# EasyEDA Pro project DartCharger.eprj, schematic DartCharger (continued)
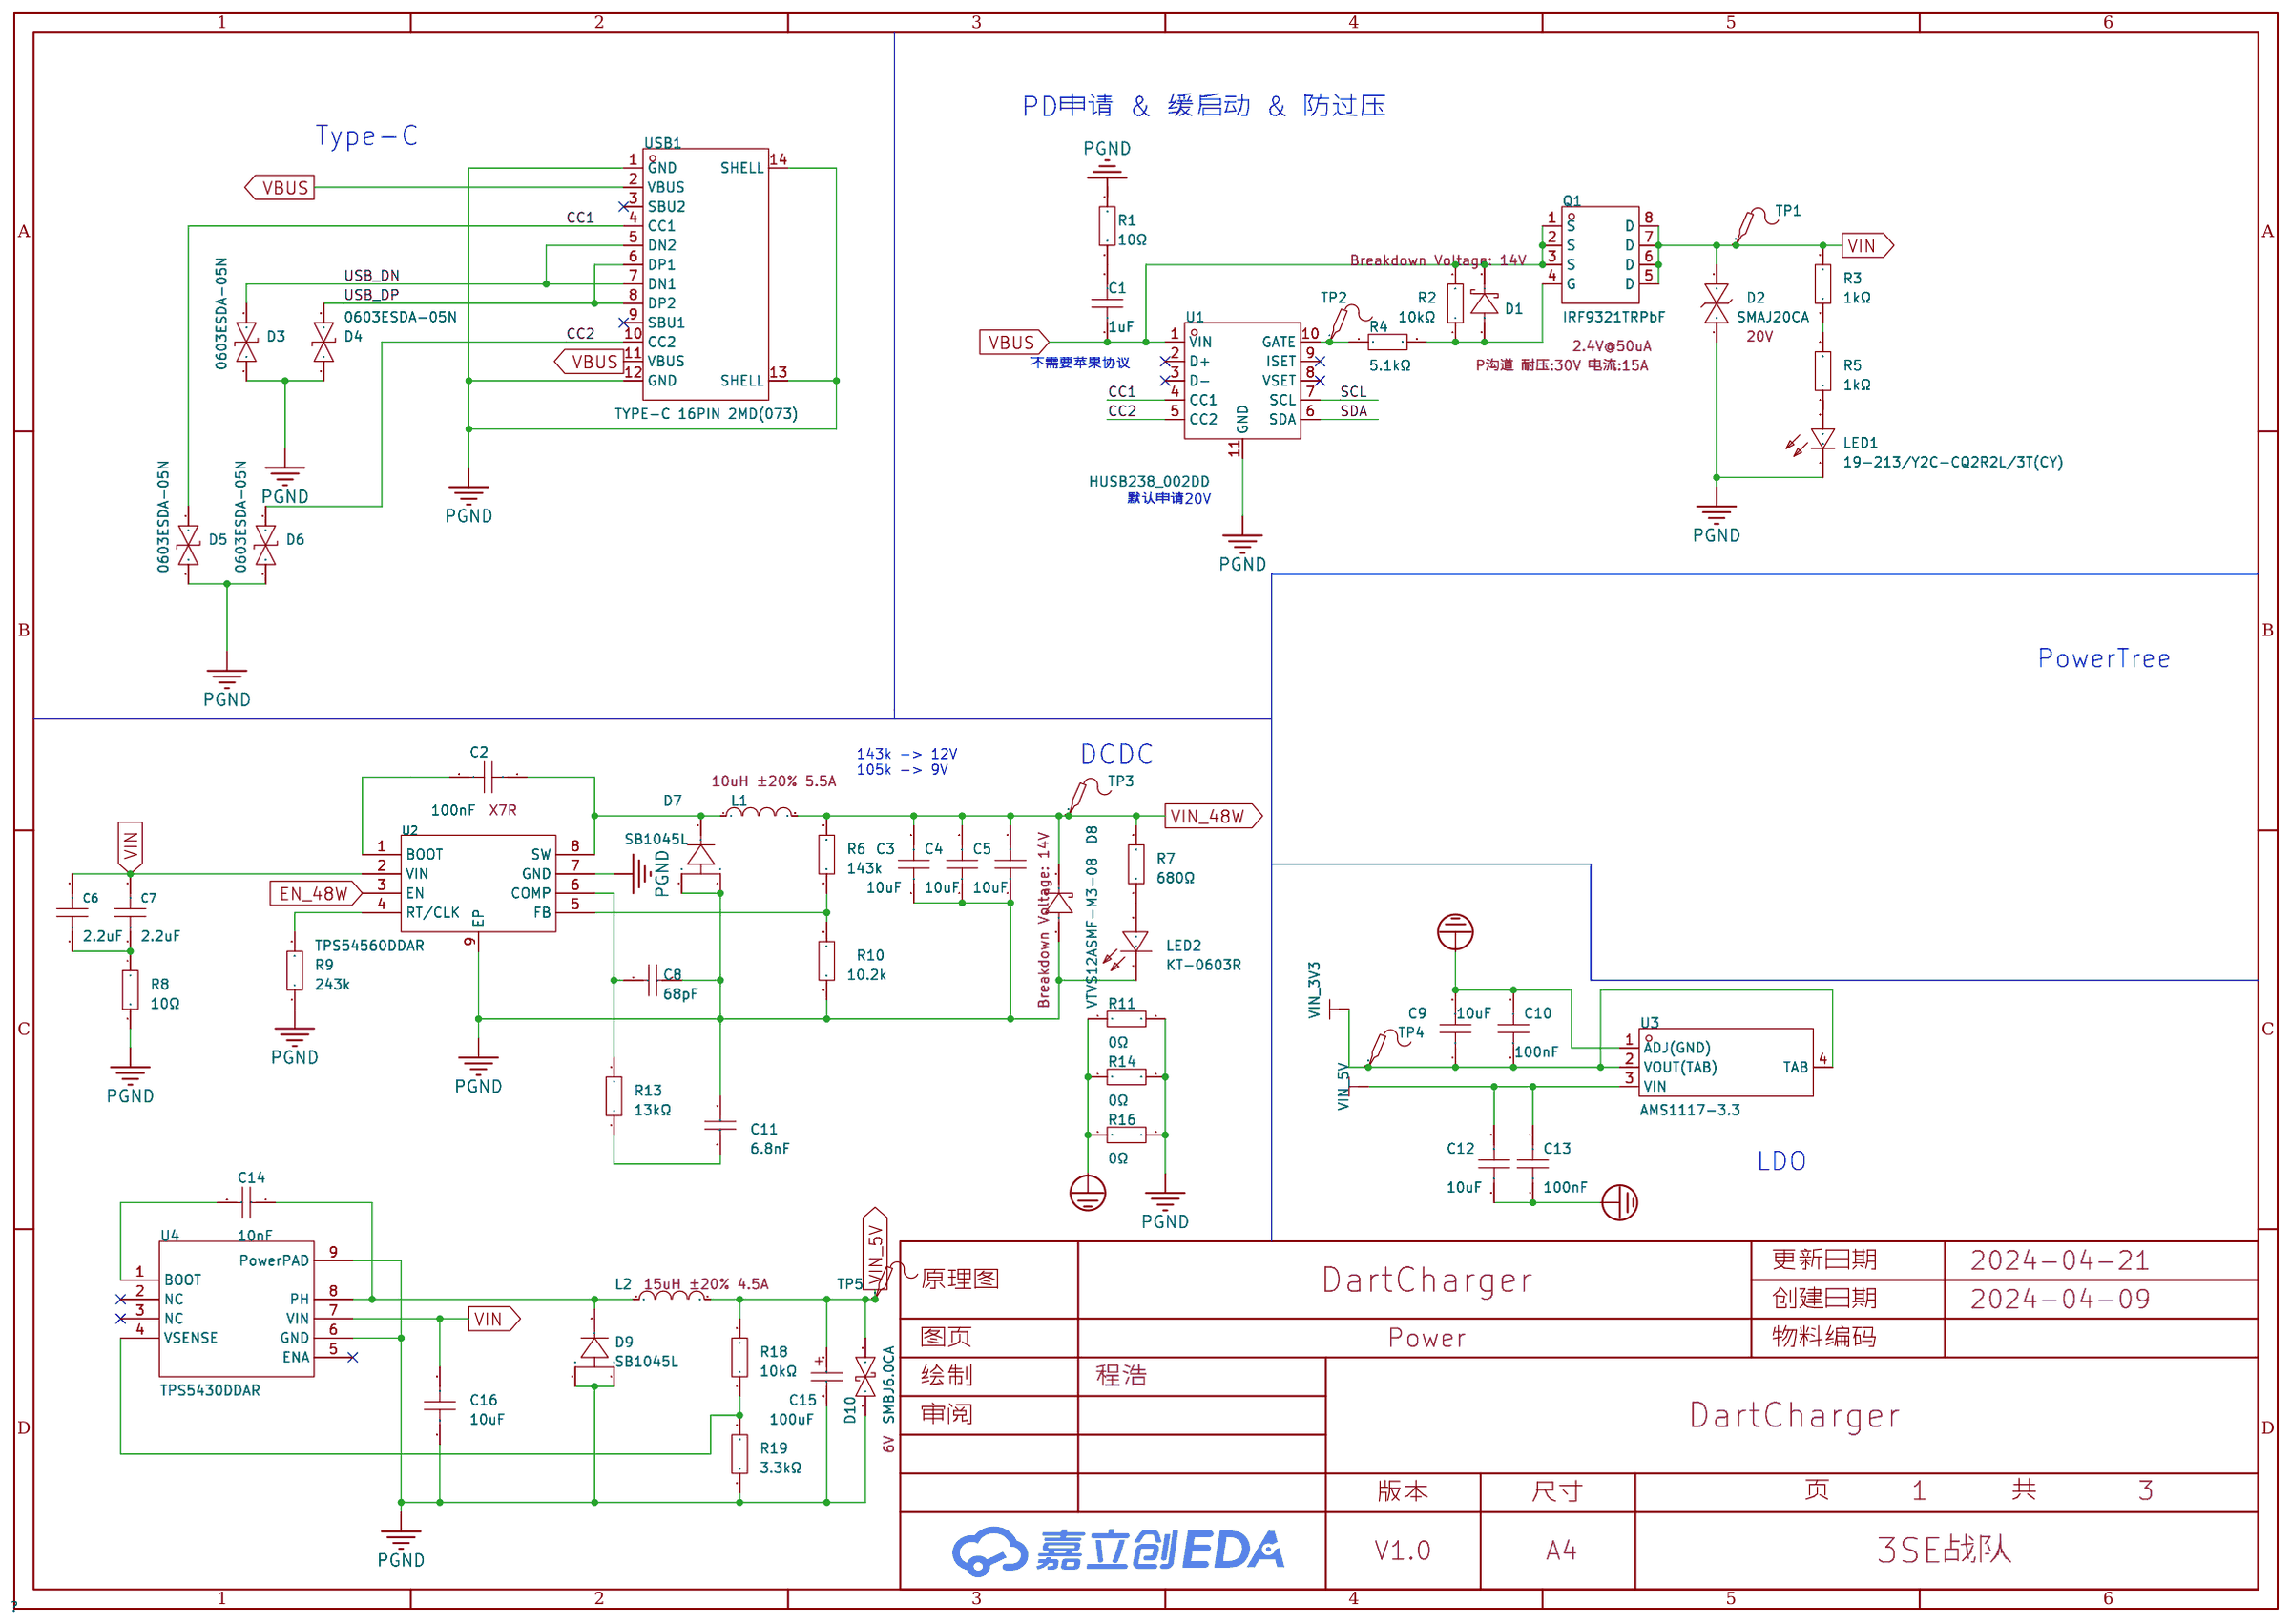
[diagram p0: Power]
## Library data of the parts (continued)
R2 R18 R29 R32 R51 R54 R64 R66 R67 R70 = 0402WGF1002TCE: 电阻类型:厚膜电阻;阻值:10kΩ;精度:±1%;功率:62.5mW;最大工作电压:50V;温度系数:±100ppm/℃;; LCSC Part Name: 10kΩ ±1% 62.5mW 厚膜电阻; Supplier Part: C25744; Manufacturer: UNI-ROYAL(厚声); Supplier Footprint: 0402; JLCPCB Part Class: 基础库; Datasheet: https://atta.szlcsc.com/upload/public/pdf/source/20200306/C422600_1E6D84923E4A46A82E41ADD87F860B5C.pdf; Supplier: LCSC; Type: 厚膜电阻; Tolerance: ±1%; Power(Watts): 62.5mW; Overload Voltage (Max): 50V; Temperature Coefficient: ±100ppm/℃; Operating Temperature Range: -55℃~+155℃
R65 = 0603WAF1002T5E: 电阻类型:厚膜电阻;阻值:10kΩ;精度:±1%;功率:100mW;最大工作电压:75V;温度系数:±100ppm/℃;; LCSC Part Name: 厚膜电阻 10kΩ ±1% 100mW; Supplier Part: C25804; Manufacturer: UNI-ROYAL(厚声); Supplier Footprint: 0603; JLCPCB Part Class: 基础库; Datasheet: https://atta.szlcsc.com/upload/public/pdf/source/20200306/C422600_1E6D84923E4A46A82E41ADD87F860B5C.pdf; Supplier: LCSC; Type: 厚膜电阻; Tolerance: ±1%; Power(Watts): 100mW; Overload Voltage (Max): 75V; Temperature Coefficient: ±100ppm/℃; Operating Temperature Range: -55℃~+155℃
R68 R69 = 0402WGF2001TCE: 电阻类型:厚膜电阻;阻值:2kΩ;精度:±1%;功率:62.5mW;最大工作电压:50V;温度系数:±100ppm/℃;; LCSC Part Name: 2kΩ ±1% 62.5mW 厚膜电阻; Supplier Part: C4109; Manufacturer: UNI-ROYAL(厚声); Supplier Footprint: 0402; JLCPCB Part Class: 基础库; Datasheet: https://atta.szlcsc.com/upload/public/pdf/source/20200306/C422600_1E6D84923E4A46A82E41ADD87F860B5C.pdf; Supplier: LCSC; Type: 厚膜电阻; Tolerance: ±1%; Power(Watts): 62.5mW; Overload Voltage (Max): 50V; Temperature Coefficient: ±100ppm/℃; Operating Temperature Range: -55℃~+155℃
SW1 SW2 = TS-1101-C-W: 触点电流:50mA;额定电压(AC):-;额定电压(DC):12V;额定功率:-;绝缘电阻:-;电路结构:单刀单掷;安装方式:立贴;带灯:无;作用力:260gf;机械寿命:5万次;带支架:否;; LCSC Part Name: 立贴 6*3.6*2.5mm 轻触开关 一型3*6*2.5有白ZD b拉伸白色带淡绿按键 卷装; Supplier Part: C318938; Manufacturer: XKB Connectivity(中国星坤); Supplier Footprint: SMD; JLCPCB Part Class: 扩展库; Datasheet: https://atta.szlcsc.com/upload/public/pdf/source/20200227/C318938_C2E53B1EEDE37D980A33616AC086DE53.pdf; Supplier: LCSC; Contact Current: 50mA; Voltage Rating (DC): 12V; Circuit: 单刀单掷; Mounting Style: 立贴; Actuator Style: 矩形按钮; Actuator/Cap Color: 白色带淡绿; With Lamp: 无; Operating Force: 260gf; Mechanical Life: 5万次; Operating Temperature: -30℃~+85℃; Switch Length: 6mm; Switch Width: 3.6mm; Switch Height: 2.5mm; Strike Gundam: 否
TP1-TP8 = Test-Point: Test Point 测试点
U9 = ESP32-S3-WROOM-1-N8R8: Supplier Part: C2913201; Manufacturer: ESPRESSIF(乐鑫); Supplier Footprint: SMD,25.5x18mm; JLCPCB Part Class: 扩展库; Datasheet: https://atta.szlcsc.com/upload/public/pdf/source/20240130/9D71F4DF55874C504AB629FEEE3F038E.pdf; Supplier: LCSC
C2 C10 C13 C28 C32-C34 C41 C42 C54 C58-C60 C67 C68 = CC0603KRX7R9BB104: 容值:100nF;精度:±10%;额定电压:50V;材质(温度系数):X7R;; LCSC Part Name: 100nF ±10% 50V; Supplier Part: C14663; Manufacturer: YAGEO(国巨); Supplier Footprint: 0603; JLCPCB Part Class: 基础库; Datasheet: https://atta.szlcsc.com/upload/public/pdf/source/20180910/C282072_33301C7F631E79921B82A8DAC6BCC5B3.pdf; Supplier: LCSC; Tolerance: ±10%; Voltage Rated: 50V; Temperature Coefficient: X7R
C3-C5 = CL31B106KBHNNNE: 容值:10uF;精度:±10%;额定电压:50V;材质(温度系数):X7R;; LCSC Part Name: 10uF ±10% 50V; Supplier Part: C89632; Manufacturer: SAMSUNG(三星); Supplier Footprint: 1206; JLCPCB Part Class: 扩展库; Datasheet: https://atta.szlcsc.com/upload/public/pdf/source/20161130/1480498807789.pdf; Supplier: LCSC; Tolerance: ±10%; Voltage Rated: 50V; Temperature Coefficient: X7R
C6 C7 = CL10A225KB8NNNC: 容值:2.2uF;精度:±10%;额定电压:50V;材质(温度系数):X5R;; LCSC Part Name: 2.2uF ±10% 50V; Supplier Part: C913904; Manufacturer: SAMSUNG(三星); Supplier Footprint: 0603; JLCPCB Part Class: 扩展库; Datasheet: https://atta.szlcsc.com/upload/public/pdf/source/20160218/1457707763339.pdf; Supplier: LCSC; Tolerance: ±10%; Voltage Rated: 50V; Temperature Coefficient: X5R
C8 = CL10C680JB8NNNC: 容值:68pF;精度:±5%;额定电压:50V;材质(温度系数):C0G;; LCSC Part Name: 68pF ±5% 50V; Supplier Part: C28262; Manufacturer: SAMSUNG(三星); Supplier Footprint: 0603; JLCPCB Part Class: 扩展库; Datasheet: https://atta.szlcsc.com/upload/public/pdf/source/20160218/1457707763339.pdf; Supplier: LCSC; Tolerance: ±5%; Voltage Rated: 50V; Temperature Coefficient: C0G
C9 C12 = CL10A106KP8NNNC: 容值:10uF;精度:±10%;额定电压:10V;材质(温度系数):X5R;; LCSC Part Name: 10uF ±10% 10V; Supplier Part: C19702; Manufacturer: SAMSUNG(三星); Supplier Footprint: 0603; JLCPCB Part Class: Basic Part; Datasheet: https://atta.szlcsc.com/upload/public/pdf/source/20160218/1457707763339.pdf; Supplier: LCSC; Tolerance: ±10%; Voltage Rated: 10V; Temperature Coefficient: X5R
C11 = 0603B682K500NT: 容值:6.8nF;精度:±10%;额定电压:50V;材质(温度系数):X7R;; LCSC Part Name: 6.8nF ±10% 50V; Supplier Part: C1631; Manufacturer: FH(风华); Supplier Footprint: 0603; JLCPCB Part Class: 基础库; Datasheet: https://atta.szlcsc.com/upload/public/pdf/source/20200305/C486355_26A10D38EF8C2A5C37091D0039909270.pdf; Supplier: LCSC; Tolerance: ±10%; Voltage Rated: 50V; Temperature Coefficient: X7R
C14 C39 C40 C65 C66 = 0603B103K500NT: 容值:10nF;精度:±10%;额定电压:50V;材质(温度系数):X7R;; LCSC Part Name: 10nF ±10% 50V; Supplier Part: C57112; Manufacturer: FH(风华); Supplier Footprint: 0603; JLCPCB Part Class: 基础库; Datasheet: https://atta.szlcsc.com/upload/public/pdf/source/20200305/C486355_26A10D38EF8C2A5C37091D0039909270.pdf; Supplier: LCSC; Tolerance: ±10%; Voltage Rated: 50V; Temperature Coefficient: X7R
C15 = TAJB107K006RNJ: 容值:100uF;精度:±10%;额定电压:6.3V;等效串联电阻:1.7Ω@100kHz;; LCSC Part Name: 100uF ±10% 6.3V; Supplier Part: C16133; Manufacturer: Kyocera AVX; Supplier Footprint: CASE-B-3528; JLCPCB Part Class: 基础库; Datasheet: https://atta.szlcsc.com/upload/public/pdf/source/20160107/1457707750344.pdf; Supplier: LCSC; Tolerance: ±10%; Rated Voltage: 6.3V; Equivalent Series Resistance(ESR): 1.7Ω@100kHz; Operating Temperature: -55℃~+125℃
C16 = CL10A106MA8NRNC: 容值:10uF;精度:±20%;额定电压:25V;材质(温度系数):X5R;; LCSC Part Name: 10uF ±20% 25V; Supplier Part: C96446; Manufacturer: SAMSUNG(三星); Supplier Footprint: 0603; JLCPCB Part Class: 基础库; Datasheet: https://atta.szlcsc.com/upload/public/pdf/source/20160218/1457707763339.pdf; Supplier: LCSC; Tolerance: ±20%; Voltage Rated: 25V; Temperature Coefficient: X5R
D1 D8 = VTVS12ASMF-M3-08: 反向截止电压(Vrwm):12.4V;最大钳位电压:20.1V;峰值脉冲电流(Ipp)@10/1000us:19.01A;峰值脉冲功率(Ppp)@10/1000us:400W;击穿电压:14V;; Supplier Part: C1856655; Manufacturer: VISHAY(威世); Supplier Footprint: DO-219AB(SMF); JLCPCB Part Class: 扩展库; Datasheet: https://atta.szlcsc.com/upload/public/pdf/source/20210601/A9A054684D086DF0A118DDF918624B00.pdf; Supplier: LCSC; Reverse Stand-Off Voltage (Vrwm): 12.4V; Maximum Clamping Voltage: 20.1V; Peak Pulse Current (Ipp)@10/1000us: 19.01A; Peak Pulse Power Dissipation (Ppp)@10/1000us: 400W; Breakdown Voltage: 14V; Type: TVS
D2 = SMAJ20CA_1: 20V; Supplier Part: C19077540; Manufacturer: 宏迦橙; Supplier Footprint: SMA; Datasheet: https://atta.szlcsc.com/upload/public/pdf/source/20231129/0C227A9DBE0C7CC8A214145DDE9DB6E3.pdf; Supplier: LCSC
D7 D9 = SB1045L_C908747: 二极管配置:独立式;正向压降(Vf):530mV@10A;直流反向耐压(Vr):45V;平均整流电流(Io):10A;; LCSC Part Name: 电压:45V 电流:10A; Supplier Part: C908747; Manufacturer: GOODWORK(固得沃克); Supplier Footprint: TO-277; JLCPCB Part Class: 扩展库; Datasheet: https://atta.szlcsc.com/upload/public/pdf/source/20210105/C908747_DE348528BC53D9CC51537B568EB9903F.pdf; Supplier: LCSC; Diode Configuration: 独立式; Forward Voltage (Vf@If): 530mV@10A; Reverse Voltage (Vr): 45V; Average Rectified Current (Io): 10A; Reverse Leakage Current (Ir): 150uA@45V
D10 = SMBJ6.0CA_C113977: 反向截止电压(Vrwm):6V;最大钳位电压:10.3V;峰值脉冲电流(Ipp)@10/1000us:58.3A;击穿电压:6.67V;; LCSC Part Name: 双向 Vrwm:6V; Supplier Part: C113977; Manufacturer: MDD; Supplier Footprint: SMB(DO-214AA); JLCPCB Part Class: 扩展库; Datasheet: https://atta.szlcsc.com/upload/public/pdf/source/20230314/C8F66EF07395B88C11214ABD10019202.pdf; Supplier: LCSC; Reverse Stand-Off Voltage (Vrwm): 6V; Maximum Clamping Voltage: 10.3V; Peak Pulse Current (Ipp)@10/1000us: 58.3A; Breakdown Voltage: 6.67V; Reverse Leakage Current (Ir): 800uA; Type: TVS
L1 = FXL0630-100-M: 电感值:10uH;精度:±20%;额定电流:4.5A;饱和电流(Isat):5.5A;类型:一体成型电感;; LCSC Part Name: 10uH ±20% 5.5A; Supplier Part: C167223; Manufacturer: cjiang(长江微电); Supplier Footprint: SMD,6.6x7mm; JLCPCB Part Class: 扩展库; Datasheet: https://atta.szlcsc.com/upload/public/pdf/source/20230516/3A080F5AF8C87BB81C3BA86E5F60E51A.pdf; Supplier: LCSC; Tolerance: ±20%; Rated Current: 4.5A; Saturation Current (Isat): 5.5A; DC Resistance (DCR): 68mΩ; Type: 一体成型电感
L2 = FXL0630-150-M: 电感值:15uH;精度:±20%;额定电流:3A;饱和电流(Isat):4.5A;类型:一体成型电感;; LCSC Part Name: 15uH ±20% 4.5A; Supplier Part: C177243; Manufacturer: cjiang(长江微电); Supplier Footprint: SMD,6.6x7mm; JLCPCB Part Class: 扩展库; Datasheet: https://atta.szlcsc.com/upload/public/pdf/source/20230516/3A080F5AF8C87BB81C3BA86E5F60E51A.pdf; Supplier: LCSC; Tolerance: ±20%; Rated Current: 3A; Saturation Current (Isat): 4.5A; DC Resistance (DCR): 115mΩ; Type: 一体成型电感
LED1 = 19-213/Y2C-CQ2R2L/3T(CY): 发光颜色:黄色;功率:60mW;正向电流:20mA;主波长:585.5nm~591.5nm;二极管配置:-;透镜颜色:无色透明透镜;色温:-;发光角度:120°;载带方式:-;工作温度:-40℃~+85℃;; LCSC Part Name: 黄灯; Supplier Part: C72038; Manufacturer: EVERLIGHT(亿光); Supplier Footprint: 0603; JLCPCB Part Class: 基础库; Datasheet: https://atta.szlcsc.com/upload/public/pdf/source/20160507/1462613613586.pdf; Supplier: LCSC; Emitted Color: 黄色; Power Dissipation: 60mW; Forward Current: 20mA; Dominant Wavelength: 585.5nm~591.5nm; Peak Wavelength: 591nm; Lens Color: 无色透明透镜; Viewing Angle: 120°; Operating Temperature: -40℃~+85℃
LED2 = KT-0603R: 发光颜色:红色;功率:-;正向电流:-;主波长:-;二极管配置:-;透镜颜色:-;色温:-;发光角度:-;载带方式:-;工作温度:-40℃~+85℃;; LCSC Part Name: 0603 红灯 高亮; Supplier Part: C2286; Manufacturer: KENTO; Supplier Footprint: 0603; JLCPCB Part Class: 基础库; Datasheet: https://atta.szlcsc.com/upload/public/pdf/source/20160616/1466072038404.pdf; Supplier: LCSC; Emitted Color: 红色; Operating Temperature: -40℃~+85℃
Q1 = IRF9321TRPbF: 类型:P沟道;漏源电压(Vdss):30V;连续漏极电流(Id):15A;功率(Pd):2.5W;导通电阻(RDS(on)@Vgs,Id):7.2mΩ@10V,15A;阈值电压(Vgs(th)@Id):2.4V@50uA;; LCSC Part Name: P沟道 耐压:30V 电流:15A; Supplier Part: C54807; Manufacturer: Infineon(英飞凌); Supplier Footprint: SOIC-8; JLCPCB Part Class: 扩展库; Datasheet: https://atta.szlcsc.com/upload/public/pdf/source/20180112/C54807_15157259574841261832.pdf; Supplier: LCSC; Type: P沟道; Drain Source Voltage (Vdss): 30V; Continuous Drain Current (Id): 15A; Power Dissipation (Pd): 2.5W; Drain Source On Resistance (RDS(on)@Vgs,Id): 7.2mΩ@10V,15A; Gate Threshold Voltage (Vgs(th)@Id): 2.4V@50uA; Total Gate Charge (Qg@Vgs): 98nC@10V; Input Capacitance (Ciss@Vds): 2.59nF@25V; Operating Temperature: -55℃~+150℃@(Tj)
R1 = 0402WGF100JTCE: 电阻类型:厚膜电阻;阻值:10Ω;精度:±1%;功率:62.5mW;最大工作电压:50V;温度系数:±200ppm/℃;; LCSC Part Name: 10Ω ±1% 62.5mW 厚膜电阻; Supplier Part: C25077; Manufacturer: UNI-ROYAL(厚声); Supplier Footprint: 0402; JLCPCB Part Class: 基础库; Datasheet: https://atta.szlcsc.com/upload/public/pdf/source/20200306/C422600_1E6D84923E4A46A82E41ADD87F860B5C.pdf; Supplier: LCSC; Type: 厚膜电阻; Tolerance: ±1%; Power(Watts): 62.5mW; Overload Voltage (Max): 50V; Temperature Coefficient: ±200ppm/℃; Operating Temperature Range: -55℃~+155℃
R3 R5 = 0603WAF1001T5E: 电阻类型:厚膜电阻;阻值:1kΩ;精度:±1%;功率:100mW;最大工作电压:75V;温度系数:±100ppm/℃;; LCSC Part Name: 1kΩ ±1% 100mW 厚膜电阻; Supplier Part: C21190; Manufacturer: UNI-ROYAL(厚声); Supplier Footprint: 0603; JLCPCB Part Class: 基础库; Datasheet: https://atta.szlcsc.com/upload/public/pdf/source/20200306/C422600_1E6D84923E4A46A82E41ADD87F860B5C.pdf; Supplier: LCSC; Type: 厚膜电阻; Tolerance: ±1%; Power(Watts): 100mW; Overload Voltage (Max): 75V; Temperature Coefficient: ±100ppm/℃; Operating Temperature Range: -55℃~+155℃
R4 = 0402WGF5101TCE: 电阻类型:厚膜电阻;阻值:5.1kΩ;精度:±1%;功率:62.5mW;最大工作电压:50V;温度系数:±100ppm/℃;; LCSC Part Name: 5.1kΩ ±1% 62.5mW 厚膜电阻; Supplier Part: C25905; Manufacturer: UNI-ROYAL(厚声); Supplier Footprint: 0402; JLCPCB Part Class: 基础库; Datasheet: https://atta.szlcsc.com/upload/public/pdf/source/20200306/C422600_1E6D84923E4A46A82E41ADD87F860B5C.pdf; Supplier: LCSC; Type: 厚膜电阻; Tolerance: ±1%; Power(Watts): 62.5mW; Overload Voltage (Max): 50V; Temperature Coefficient: ±100ppm/℃; Operating Temperature Range: -55℃~+155℃
R6 R9 R10 = Res_0603: Supplier Footprint: 0603
R7 = 0805W8F6800T5E: 电阻类型:厚膜电阻;阻值:680Ω;精度:±1%;功率:125mW;最大工作电压:150V;温度系数:±100ppm/℃;; LCSC Part Name: 680Ω ±1% 125mW 厚膜电阻; Supplier Part: C17798; Manufacturer: UNI-ROYAL(厚声); Supplier Footprint: 0805; JLCPCB Part Class: 基础库; Datasheet: https://atta.szlcsc.com/upload/public/pdf/source/20200306/C422600_1E6D84923E4A46A82E41ADD87F860B5C.pdf; Supplier: LCSC; Type: 厚膜电阻; Tolerance: ±1%; Power(Watts): 125mW; Overload Voltage (Max): 150V; Temperature Coefficient: ±100ppm/℃; Operating Temperature Range: -55℃~+155℃
R8 = 0603WAF100JT5E: 电阻类型:厚膜电阻;阻值:10Ω;精度:±1%;功率:100mW;最大工作电压:75V;温度系数:±400ppm/℃;; LCSC Part Name: 10Ω ±1% 100mW 厚膜电阻; Supplier Part: C22859; Manufacturer: UNI-ROYAL(厚声); Supplier Footprint: 0603; JLCPCB Part Class: 基础库; Datasheet: https://atta.szlcsc.com/upload/public/pdf/source/20200306/C422600_1E6D84923E4A46A82E41ADD87F860B5C.pdf; Supplier: LCSC; Type: 厚膜电阻; Tolerance: ±1%; Power(Watts): 100mW; Overload Voltage (Max): 75V; Temperature Coefficient: ±400ppm/℃; Operating Temperature Range: -55℃~+155℃
R11 R14 R16 R22 R23 R28 R31 R44 R45 R50 R53 = 0603WAF0000T5E: 电阻类型:厚膜电阻;阻值:0Ω;精度:±1%;功率:100mW;最大工作电压:75V;; LCSC Part Name: 0Ω ±1% 100mW 厚膜电阻; Supplier Part: C21189; Manufacturer: UNI-ROYAL(厚声); Supplier Footprint: 0603; JLCPCB Part Class: 基础库; Datasheet: https://atta.szlcsc.com/upload/public/pdf/source/20200306/C422600_1E6D84923E4A46A82E41ADD87F860B5C.pdf; Supplier: LCSC; Type: 厚膜电阻; Tolerance: ±1%; Power(Watts): 100mW; Overload Voltage (Max): 75V; Operating Temperature Range: -55℃~+155℃
R13 = 0603WAF1302T5E: 电阻类型:厚膜电阻;阻值:13kΩ;精度:±1%;功率:100mW;最大工作电压:75V;温度系数:±100ppm/℃;; LCSC Part Name: 13kΩ ±1% 100mW 厚膜电阻; Supplier Part: C22797; Manufacturer: UNI-ROYAL(厚声); Supplier Footprint: 0603; JLCPCB Part Class: 基础库; Datasheet: https://atta.szlcsc.com/upload/public/pdf/source/20200306/C422600_1E6D84923E4A46A82E41ADD87F860B5C.pdf; Supplier: LCSC; Type: 厚膜电阻; Tolerance: ±1%; Power(Watts): 100mW; Overload Voltage (Max): 75V; Temperature Coefficient: ±100ppm/℃; Operating Temperature Range: -55℃~+155℃
R19 R25 R27 R47 R49 = 0402WGF3301TCE: 电阻类型:厚膜电阻;阻值:3.3kΩ;精度:±1%;功率:62.5mW;最大工作电压:50V;温度系数:±100ppm/℃;; LCSC Part Name: 3.3kΩ ±1% 62.5mW 厚膜电阻; Supplier Part: C25890; Manufacturer: UNI-ROYAL(厚声); Supplier Footprint: 0402; JLCPCB Part Class: 基础库; Datasheet: https://atta.szlcsc.com/upload/public/pdf/source/20200306/C422600_1E6D84923E4A46A82E41ADD87F860B5C.pdf; Supplier: LCSC; Type: 厚膜电阻; Tolerance: ±1%; Power(Watts): 62.5mW; Overload Voltage (Max): 50V; Temperature Coefficient: ±100ppm/℃; Operating Temperature Range: -55℃~+155℃
U1 = HUSB238_002DD: HUSB238是一款高度集成的USB PD受电端芯片（PD Sink，也叫PD诱骗芯片）。传输的额定功率可达100W。它兼容PD3.0 V1.3和Type-C V1.4。它还可以支持BC1.2 DCP、CDP和SDP和Apple 5V2.4A充电协议。这种方案也被称为桶形连接器替换(Barrel Connector Replacement)，旨在替代传统的桶形连接器和DC插座(DC JACK)。HUSB238已经获得USB-IF认证，TID3666。它可以用于具有传统桶形连接器或USB micro-B电源; Supplier Part: C7471904; Manufacturer: Hynetek(慧能泰); Supplier Footprint: DFN-10L; JLCPCB Part Class: 扩展库; Datasheet: https://atta.szlcsc.com/upload/public/pdf/source/20240407/14E2BCB22C39B22B34E48E1B6FC2FE3E.pdf; Supplier: LCSC
U2 = TPS54560DDAR: 功能类型:降压型;输出类型:可调;输入电压:4.5V~60V;输出电压:800mV~58.8V;输出电流(最大值):5A;; Supplier Part: C31966; Manufacturer: TI(德州仪器); Supplier Footprint: SOIC-8-EP; JLCPCB Part Class: 扩展库; Datasheet: https://www.ti.com/cn/lit/gpn/tps54560; Supplier: LCSC; Function: 降压型; Output Type: 可调; Input Voltage: 4.5V~60V; Output Voltage: 800mV~58.8V; Output Current (Max): 5A; Switching Frequency: 2.5MHz; Operating Temperature: -40℃~+150℃@(TJ); Synchronous Rectification: 否; Number of Outputs: 1; Topology: 降压式; Switch tube (built-in/external): 内置
U3 = AMS1117-3.3_C347222: 输出类型:固定;最大输入电压:18V;输出电压:3.3V;输出电流:1A;电源纹波抑制比(PSRR):60dB@(120Hz);输出极性:正;; LCSC Part Name: 输入18V 输出3.3V 1A; Supplier Part: C347222; Manufacturer: UMW(友台半导体); Supplier Footprint: SOT-223; JLCPCB Part Class: Extended Part; Datasheet: https://atta.szlcsc.com/upload/public/pdf/source/20231109/155D79A26D9DB04352555A58D5969DC8.pdf; Supplier: LCSC; Output Type: 固定; Output Polarity: 正; Number of Outputs: 1; Maximum Input Voltage: 18V; Output Voltage: 3.3V; Dropout Voltage: 1.3V@(1A); Output Current: 1A; Power Supply Rejection Ratio (PSRR): 60dB@(120Hz)
U4 = TPS5430DDAR: 功能类型:降压型;输出类型:可调;输入电压:5.5V~36V;输出电压:1.221V~32.04V;输出电流(最大值):3A;; LCSC Part Name: 降压 3A 36V; Supplier Part: C9864; Manufacturer: TI(德州仪器); Supplier Footprint: SOIC-8-EP; JLCPCB Part Class: 基础库; Datasheet: https://www.ti.com/cn/lit/gpn/tps5430; Supplier: LCSC; Function: 降压型; Output Type: 可调; Input Voltage: 5.5V~36V; Output Voltage: 1.221V~32.04V; Output Current (Max): 3A; Switching Frequency: 500kHz; Operating Temperature: -40℃~+125℃@(TJ); Synchronous Rectification: 否; Number of Outputs: 1; Topology: 降压式; Switch tube (built-in/external): 内置
USB1 = TYPE-C 16PIN 2MD(073): 连接器类型:Type-C;标准:-;公母:母;端口数量:1;触点数量:16P;安装方式:卧贴;额定电流 - 电源:5A;工作温度范围:-25℃~+85℃;; LCSC Part Name: Type-C 母 卧贴; Supplier Part: C2765186; Manufacturer: SHOU HAN(首韩); Supplier Footprint: SMD; JLCPCB Part Class: 扩展库; Datasheet: https://atta.szlcsc.com/upload/public/pdf/source/20211123/39B17C16241EAC15C5E277BDA434118E.pdf; Supplier: LCSC; Connector Type: Type-C; Gender: 母; Number of Ports: 1; Number of Contacts: 16P; Mounting Style: 卧贴; Current Rating - Power (Max): 5A; Operating Temperature Range: -25℃~+85℃
C17-C20 C43-C46 = CC0603KRX7R9BB153: 容值:15nF;精度:±10%;额定电压:50V;材质(温度系数):X7R;; LCSC Part Name: 15nF ±10% 50V; Supplier Part: C107076; Manufacturer: YAGEO(国巨); Supplier Footprint: 0603; JLCPCB Part Class: 扩展库; Datasheet: https://atta.szlcsc.com/upload/public/pdf/source/20180910/C282072_33301C7F631E79921B82A8DAC6BCC5B3.pdf; Supplier: LCSC; Tolerance: ±10%; Voltage Rated: 50V; Temperature Coefficient: X7R
C21-C24 C47-C50 = 0603B222K500NT: 容值:2.2nF;精度:±10%;额定电压:50V;材质(温度系数):X7R;; LCSC Part Name: 2.2nF ±10% 50V; Supplier Part: C1604; Manufacturer: FH(风华); Supplier Footprint: 0603; JLCPCB Part Class: 基础库; Datasheet: https://atta.szlcsc.com/upload/public/pdf/source/20200305/C486355_26A10D38EF8C2A5C37091D0039909270.pdf; Supplier: LCSC; Tolerance: ±10%; Voltage Rated: 50V; Temperature Coefficient: X7R
C25 C29 C51 C55 = CL10A225KO8NNNC: 容值:2.2uF;精度:±10%;额定电压:16V;材质(温度系数):X5R;; LCSC Part Name: 2.2uF ±10% 16V; Supplier Part: C23630; Manufacturer: SAMSUNG(三星); Supplier Footprint: 0603; JLCPCB Part Class: 基础库; Datasheet: https://atta.szlcsc.com/upload/public/pdf/source/20160218/1457707763339.pdf; Supplier: LCSC; Tolerance: ±10%; Voltage Rated: 16V; Temperature Coefficient: X5R
C26 C27 C30 C31 C52 C53 C56 C57 = CL21A226MAQNNNE: 容值:22uF;精度:±20%;额定电压:25V;材质(温度系数):X5R;; LCSC Part Name: 22uF ±20% 25V; Supplier Part: C45783; Manufacturer: SAMSUNG(三星); Supplier Footprint: 0805; JLCPCB Part Class: 基础库; Datasheet: https://atta.szlcsc.com/upload/public/pdf/source/20160218/1457707763339.pdf; Supplier: LCSC; Tolerance: ±20%; Voltage Rated: 25V; Temperature Coefficient: X5R
C35-C38 C61-C64 = CL10B104KB8NNNC: 容值:100nF;精度:±10%;额定电压:50V;材质(温度系数):X7R;; LCSC Part Name: 100nF ±10% 50V; Supplier Part: C1591; Manufacturer: SAMSUNG(三星); Supplier Footprint: 0603; JLCPCB Part Class: 扩展库; Datasheet: https://atta.szlcsc.com/upload/public/pdf/source/20160218/1457707763339.pdf; Supplier: LCSC; Tolerance: ±10%; Voltage Rated: 50V; Temperature Coefficient: X7R
D11-D14 = B5819W SL: 正向压降(Vf):600mV@1A;直流反向耐压(Vr):40V;平均整流电流(Io):1A;; LCSC Part Name: 电压:40V 电流:1A; Supplier Part: C8598; Manufacturer: CJ(江苏长电/长晶); Supplier Footprint: SOD-123; JLCPCB Part Class: 基础库; Datasheet: https://atta.szlcsc.com/upload/public/pdf/source/20171228/C164911_15144413243851213914.pdf; Supplier: LCSC; Forward Voltage (Vf@If): 600mV@1A; Reverse Voltage (Vr): 40V; Average Rectified Current (Io): 1A
LED3 LED4 LED7 LED8 = KT-0805Y: 发光颜色:黄色;功率:-;正向电流:-;主波长:-;二极管配置:-;透镜颜色:-;色温:-;发光角度:-;载带方式:-;工作温度:-;; LCSC Part Name: 0805 黄灯 高亮; Supplier Part: C2296; Manufacturer: KENTO; Supplier Footprint: 0805; JLCPCB Part Class: 基础库; Datasheet: https://atta.szlcsc.com/upload/public/pdf/source/20160421/1461205044170.pdf; Supplier: LCSC; Emitted Color: 黄色
LED5 LED6 LED9 LED10 = KT-0805G: 灯头类型:-;发光颜色:翠绿色;正向电压(VF):-;功率:-;正向电流:-;主波长:-;二极管配置:-;透镜颜色:-;色温:-;发光强度:-;发光角度:-;载带方式:-;工作温度:-;; LCSC Part Name: 0805 翠绿 高亮; Supplier Part: C2297; Manufacturer: KENTO; Supplier Footprint: 0805; JLCPCB Part Class: 基础库; Datasheet: https://atta.szlcsc.com/upload/public/pdf/source/20170209/1486607340485.pdf; Supplier: LCSC; Emitted Color: 翠绿色
R20 R21 R42 R43 = 0402WGF3302TCE: 电阻类型:厚膜电阻;阻值:33kΩ;精度:±1%;功率:62.5mW;最大工作电压:50V;温度系数:±100ppm/℃;; LCSC Part Name: 33kΩ ±1% 62.5mW 厚膜电阻; Supplier Part: C25779; Manufacturer: UNI-ROYAL(厚声); Supplier Footprint: 0402; JLCPCB Part Class: 基础库; Datasheet: https://atta.szlcsc.com/upload/public/pdf/source/20200306/C422600_1E6D84923E4A46A82E41ADD87F860B5C.pdf; Supplier: LCSC; Type: 厚膜电阻; Tolerance: ±1%; Power(Watts): 62.5mW; Overload Voltage (Max): 50V; Temperature Coefficient: ±100ppm/℃; Operating Temperature Range: -55℃~+155℃
R24 R26 R46 R48 = 0603WAF200MT5E: 电阻类型:厚膜电阻;阻值:20mΩ;精度:±1%;功率:100mW;最大工作电压:75V;温度系数:±1500ppm/℃;; LCSC Part Name: 20mΩ ±1% 100mW 厚膜电阻; Supplier Part: C422963; Manufacturer: UNI-ROYAL(厚声); Supplier Footprint: 0603; JLCPCB Part Class: 扩展库; Datasheet: https://atta.szlcsc.com/upload/public/pdf/source/20200306/C422600_1E6D84923E4A46A82E41ADD87F860B5C.pdf; Supplier: LCSC; Type: 厚膜电阻; Tolerance: ±1%; Power(Watts): 100mW; Overload Voltage (Max): 75V; Temperature Coefficient: ±1500ppm/℃; Operating Temperature Range: -55℃~+155℃
R30 R33-R35 R52 R55-R57 = 0402WGF1003TCE: 电阻类型:厚膜电阻;阻值:100kΩ;精度:±1%;功率:62.5mW;最大工作电压:50V;温度系数:±100ppm/℃;; LCSC Part Name: 100kΩ ±1% 62.5mW 厚膜电阻; Supplier Part: C25741; Manufacturer: UNI-ROYAL(厚声); Supplier Footprint: 0402; JLCPCB Part Class: 基础库; Datasheet: https://atta.szlcsc.com/upload/public/pdf/source/20200306/C422600_1E6D84923E4A46A82E41ADD87F860B5C.pdf; Supplier: LCSC; Type: 厚膜电阻; Tolerance: ±1%; Power(Watts): 62.5mW; Overload Voltage (Max): 50V; Temperature Coefficient: ±100ppm/℃; Operating Temperature Range: -55℃~+155℃
R36 R37 R58 R59 = 0603WAF1003T5E: 电阻类型:厚膜电阻;阻值:100kΩ;精度:±1%;功率:100mW;最大工作电压:75V;温度系数:±100ppm/℃;; LCSC Part Name: 100kΩ ±1% 100mW 厚膜电阻; Supplier Part: C25803; Manufacturer: UNI-ROYAL(厚声); Supplier Footprint: 0603; JLCPCB Part Class: 基础库; Datasheet: https://atta.szlcsc.com/upload/public/pdf/source/20200306/C422600_1E6D84923E4A46A82E41ADD87F860B5C.pdf; Supplier: LCSC; Type: 厚膜电阻; Tolerance: ±1%; Power(Watts): 100mW; Overload Voltage (Max): 75V; Temperature Coefficient: ±100ppm/℃; Operating Temperature Range: -55℃~+155℃
R38-R41 R60-R63 = 0402WGF1001TCE: 电阻类型:厚膜电阻;阻值:1kΩ;精度:±1%;功率:62.5mW;最大工作电压:50V;温度系数:±100ppm/℃;; LCSC Part Name: 1kΩ ±1% 62.5mW 厚膜电阻; Supplier Part: C11702; Manufacturer: UNI-ROYAL(厚声); Supplier Footprint: 0402; JLCPCB Part Class: 基础库; Datasheet: https://atta.szlcsc.com/upload/public/pdf/source/20200306/C422600_1E6D84923E4A46A82E41ADD87F860B5C.pdf; Supplier: LCSC; Type: 厚膜电阻; Tolerance: ±1%; Power(Watts): 62.5mW; Overload Voltage (Max): 50V; Temperature Coefficient: ±100ppm/℃; Operating Temperature Range: -55℃~+155℃
U5-U8 = IP6826_C2921390: 无线充驱动芯片 。这个料是没有烧录固件的，白片。; LCSC Part Name: 集成15W无线充电发射器SOC 支持PD输入; Supplier Part: C2921390; Manufacturer: INJOINIC(英集芯); Supplier Footprint: QFN-32-EP(5x5); JLCPCB Part Class: 扩展库; Datasheet: https://atta.szlcsc.com/upload/public/pdf/source/20211129/7DF870B96D3DBFA5E53D39AE478269E8.pdf; Supplier: LCSC

## Nets
DGND: C9.2 C10.1 C12.1 C13.2 C69.2 C70.2 C71.2 J1.8 J1.40 J6.3 J6.5 J6.6 J7.1 J7.6 J7.7 LED11.1(GND) R11.1 R14.1 R16.1 R67.1 R70.1 SW1.2 SW2.2 U3.1(ADJ(GND)) U9.1(GND) U9.40(GND) U9.41(GND)
PGND: C3.1 C4.1 C5.1 C8.2 C11.1 C15.2 C16.1 C19.1 C20.1 C23.1 C24.1 C25.1 C29.1 C45.1 C46.1 C49.1 C50.1 C51.1 C55.1 C72.1 D2.1 D3.1 D4.1 D5.1 D6.1 D7.1(A) D7.3(A) D8.1(A) D9.1(A) D9.3(A) D10.1(K) D15.1 J8.1 LED1.1(C) LED2.1(K) LED3.2(-) LED4.2(-) LED5.2(K) LED6.2(K) LED7.2(-) LED8.2(-) LED9.2(K) LED10.2(K) Q2.2(S) R1.2 R8.2 R9.1 R10.1 R11.2 R14.2 R16.2 R19.1 R20.1 R21.1 R22.1 R23.1 R24.2 R26.2 R29.1 R32.1 R34.1 R35.1 R36.1 R37.1 R42.1 R43.1 R44.1 R45.1 R46.2 R48.2 R51.1 R54.1 R56.1 R57.1 R58.1 R59.1 U1.11(GND) U2.7(GND) U2.9(EP) U4.6(GND) U4.9(PowerPAD) U5.1(GND) U6.1(GND) U7.1(GND) U8.1(GND) USB1.1(GND) USB1.12(GND) USB1.13(SHELL) USB1.14(SHELL)
VBUS: C1.1 D1.2(K) Q1.1(S) Q1.2(S) Q1.3(S) R2.2 U1.1(VIN) USB1.2(VBUS) USB1.11(VBUS)
VIN: C6.2 C7.2 C16.2 D2.2 Q1.5(D) Q1.6(D) Q1.7(D) Q1.8(D) R3.2 TP1.1 U2.2(VIN) U4.7(VIN)
VIN_3V3: C9.1 C10.2 C69.1 C70.1 J7.2 R64.1 R65.1 R68.2 R69.2 TP4.1 U3.2(VOUT(TAB)) U3.4(TAB) U9.2(3V3)
VIN_5V: C12.2 C13.1 C15.1 D10.2(A) J1.2 J6.4 L2.2 LED11.3(VDD) R18.2 R66.2 TP5.1 U3.3(VIN)
VIN_48W: C3.2 C4.2 C5.2 C26.1 C27.1 C28.1 C30.1 C31.1 C32.1 C52.1 C53.1 C54.1 C56.1 C57.1 C58.1 C72.2 D8.2(K) J8.2 L1.2 R6.2 R7.2 TP3.1 U5.26(VIN) U5.27(VIN) U6.26(VIN) U6.27(VIN) U7.26(VIN) U7.27(VIN) U8.26(VIN) U8.27(VIN)
B3: J1.30 U9.22(IO14)
B4: J1.31 U9.31(IO38)
B5: J1.32 U9.11(IO18)
B6: J1.33 U9.10(IO17)
B7: J1.34 U9.18(IO10)
BOOT: J1.22 SW2.1 U9.27(IO0)
CC1: D5.2 U1.4(CC1) USB1.4(CC1)
CC2: D6.2 U1.5(CC2) USB1.10(CC2)
COIL_1+: C35.2 C36.2 C39.2 D11.2(+)
COIL_1-: C33.2 U5.22(LX2) U5.23(LX2)
COIL_2+: C37.2 C38.2 C40.2 D12.2(+)
COIL_2-: C34.2 U6.22(LX2) U6.23(LX2)
COIL_3+: C63.2 C64.2 C66.2 D14.2(+)
COIL_3-: C60.2 U8.22(LX2) U8.23(LX2)
COIL_4+: C61.2 C62.2 C65.2 D13.2(+)
COIL_4-: C59.2 U7.22(LX2) U7.23(LX2)
CTP_IRQ: J1.1 U9.4(IO4)
CTP_RST: J1.6 U9.19(IO11)
DE: J1.39 U9.5(IO5)
DISP: J1.36 U9.20(IO12)
EC11_CLK: J7.3 TP8.1 U9.29(IO36)
EC11_DT: J7.4 TP6.1 U9.30(IO37)
EC11_SW: J7.5 TP7.1 U9.28(IO35)
EN_48W: R70.2 U2.3(EN) U9.8(IO15)
FAN_PWM: D15.2 Q2.1(G) R67.2 U9.9(IO16)
G2: J1.21 U9.32(IO39)
G4: J1.23 U9.26(IO45)
G5: J1.24 U9.25(IO48)
G6: J1.25 U9.24(IO47)
G7: J1.26 U9.23(IO21)
HSYNC: J1.37 U9.16(IO46)
LCD_PWM: J1.7 U9.6(IO6)
PCLK: J1.35 U9.7(IO7)
R3: J1.14 U9.39(IO1)
R4: J1.15 U9.38(IO2)
R5: J1.16 U9.35(IO42)
R6: J1.17 U9.34(IO41)
R7: J1.18 U9.33(IO40)
RST: C71.1 R64.2 SW1.1 U9.3(EN)
RXD0: J6.1 U9.36(RXD0)
SCL: J1.5 R69.1 U1.7(SCL) U9.17(IO9)
SDA: J1.4 R68.1 U1.6(SDA) U9.12(IO8)
TXD0: J6.2 U9.37(TXD0)
USB_DN: D3.2 U9.13(IO19) USB1.5(DN2) USB1.7(DN1)
USB_DP: D4.2 U9.14(IO20) USB1.6(DP1) USB1.8(DP2)
V_DECODE_1: C17.2 U5.18(V_DECODE)
V_DECODE_2: C43.2 U7.18(V_DECODE)
V_DECODE_3: C18.2 U6.18(V_DECODE)
V_DECODE_4: C44.2 U8.18(V_DECODE)
VSYNC: J1.38 R65.2 U9.15(IO3)
$1N2486: R4.1 TP2.1 U1.10(GATE)
$1N2492: D1.1(A) Q1.4(G) R2.1 R4.2
$1N4957: C2.2 U2.1(BOOT)
$1N4980: C2.1 D7.2(K) L1.1 U2.8(SW)
$1N5179: R9.2 U2.4(RT/CLK)
$1N5665: C8.1 R13.2 U2.6(COMP)
$1N5784: C11.2 R13.1
$1N6075: R6.1 R10.2 U2.5(FB)
$1N6298: C6.1 C7.1 R8.1
$1N6775: C14.2 U4.1(BOOT)
$1N6972: C14.1 D9.2(K) L2.1 U4.8(PH)
$1N7288: R18.1 R19.2 U4.4(VSENSE)
$1N12562: LED1.2(A) R5.1
$1N12564: R3.1 R5.2
$1N12878: LED2.2(A) R7.1
$1N16074: C1.2 R1.1
$2N1632: LED11.2(DI) U9.21(IO13)
$2N4593: J8.4 Q2.3(D) R66.1
$3N1110: R22.2 U5.2(IGND)
$3N1114: R28.2 U5.3(ISENSE)
$3N1138: C25.2 U5.4(VCC)
$3N1317: R36.2 U5.12(LOSS_THR)
$3N1478: LED3.1(+) R38.1
$3N1648: LED5.1(A) R40.1
$3N1651: R40.2 U5.16(LED2)
$3N1655: R38.2 U5.13(LED1)
$3N1793: R34.2 U5.11(NTC)
$3N1853: C33.1 U5.24(BST2)
$3N1928: C41.2 U5.19(BST1)
$3N2268: C35.1 C36.1 C39.1 C41.1 U5.20(LX1) U5.21(LX1)
$3N2551: C21.1 C23.2 R29.2 R30.1 U5.30(VDET)
$3N2696: C21.2 U5.32(AGND)
$3N3059: C17.1 C19.2 R20.2 R25.1
$3N4796: D11.1(-) R25.2 R30.2
$3N4971: C26.2 C27.2 C28.2 R24.1 R28.1 U5.5(PGND) U5.33(EP)
$3N6138: R44.2 U7.2(IGND)
$3N6139: R50.2 U7.3(ISENSE)
$3N6140: C51.2 U7.4(VCC)
$3N6141: R58.2 U7.12(LOSS_THR)
$3N6142: LED7.1(+) R60.1
$3N6143: LED9.1(A) R62.1
$3N6144: R62.2 U7.16(LED2)
$3N6145: R60.2 U7.13(LED1)
$3N6146: R56.2 U7.11(NTC)
$3N6149: C59.1 U7.24(BST2)
$3N6150: C67.2 U7.19(BST1)
$3N6153: C61.1 C62.1 C65.1 C67.1 U7.20(LX1) U7.21(LX1)
$3N6154: C47.1 C49.2 R51.2 R52.1 U7.30(VDET)
$3N6155: C47.2 U7.32(AGND)
$3N6156: C43.1 C45.2 R42.2 R47.1
$3N6166: D13.1(-) R47.2 R52.2
$3N6180: C52.2 C53.2 C54.2 R46.1 R50.1 U7.5(PGND) U7.33(EP)
$3N7334: R23.2 U6.2(IGND)
$3N7335: R31.2 U6.3(ISENSE)
$3N7336: C29.2 U6.4(VCC)
$3N7337: R37.2 U6.12(LOSS_THR)
$3N7338: LED4.1(+) R39.1
$3N7339: LED6.1(A) R41.1
$3N7340: R41.2 U6.16(LED2)
$3N7341: R39.2 U6.13(LED1)
$3N7342: R35.2 U6.11(NTC)
$3N7345: C34.1 U6.24(BST2)
$3N7346: C42.2 U6.19(BST1)
$3N7349: C37.1 C38.1 C40.1 C42.1 U6.20(LX1) U6.21(LX1)
$3N7350: C22.1 C24.2 R32.2 R33.1 U6.30(VDET)
$3N7351: C22.2 U6.32(AGND)
$3N7352: C18.1 C20.2 R21.2 R27.1
$3N7362: D12.1(-) R27.2 R33.2
$3N7376: C30.2 C31.2 C32.2 R26.1 R31.1 U6.5(PGND) U6.33(EP)
$3N8530: R45.2 U8.2(IGND)
$3N8531: R53.2 U8.3(ISENSE)
$3N8532: C55.2 U8.4(VCC)
$3N8533: R59.2 U8.12(LOSS_THR)
$3N8534: LED8.1(+) R61.1
$3N8535: LED10.1(A) R63.1
$3N8536: R63.2 U8.16(LED2)
$3N8537: R61.2 U8.13(LED1)
$3N8538: R57.2 U8.11(NTC)
$3N8541: C60.1 U8.24(BST2)
$3N8542: C68.2 U8.19(BST1)
$3N8545: C63.1 C64.1 C66.1 C68.1 U8.20(LX1) U8.21(LX1)
$3N8546: C48.1 C50.2 R54.2 R55.1 U8.30(VDET)
$3N8547: C48.2 U8.32(AGND)
$3N8548: C44.1 C46.2 R43.2 R49.1
$3N8558: D14.1(-) R49.2 R55.2
$3N8572: C56.2 C57.2 C58.2 R48.1 R53.1 U8.5(PGND) U8.33(EP)

Not connected (* = marked no-connect by the designer): J1 3* 9* 10* 11* 12* 13* 19* 20* 27* 28* 29*; J8 3*; LED11 4(DO)*; U1 2(D+)* 3(D-)* 8(VSET)* 9(ISET)*; U4 2(NC)* 3(NC)* 5(ENA)*; U5 6(HOSCI)* 7(HOSCO)* 8(CC1)* 9(CC2)* 10(DEBUG)* 14(IO4)* 15(LED3)* 17(IO7)* 25(NC)* 28(DM)* 29(DP)* 31(NC)*; U6 6(HOSCI)* 7(HOSCO)* 8(CC1)* 9(CC2)* 10(DEBUG)* 14(IO4)* 15(LED3)* 17(IO7)* 25(NC)* 28(DM)* 29(DP)* 31(NC)*; U7 6(HOSCI)* 7(HOSCO)* 8(CC1)* 9(CC2)* 10(DEBUG)* 14(IO4)* 15(LED3)* 17(IO7)* 25(NC)* 28(DM)* 29(DP)* 31(NC)*; U8 6(HOSCI)* 7(HOSCO)* 8(CC1)* 9(CC2)* 10(DEBUG)* 14(IO4)* 15(LED3)* 17(IO7)* 25(NC)* 28(DM)* 29(DP)* 31(NC)*; USB1 3(SBU2)* 9(SBU1)*

## Notes on the sheets
sheet 1
- PD申请 & 缓启动 & 防过压
- Type-C
- 不需要苹果协议
- 默认申请20V
- PowerTree
- 143k -> 12V
  105k -> 9V
- DCDC
- LDO
sheet 2
- 46内部默认下拉
- LCD 上半径1mm 下半径自定 固定孔直径4.1mm
- Boot-RST
- Optional - JTAG选择
- 定位孔
- FAN
- UART
- EC11
- IIC
sheet 3
- 线圈：12uH RX2500
  谐振电容：210nF
- 线圈：12uH RX2500
  谐振电容：210nF
- 线圈：12uH RX2500
  谐振电容：210nF
- 线圈：12uH RX2500
  谐振电容：210nF
